# EasyEDA Pro project Access Control Core.eprj, board Card Reader (continued)
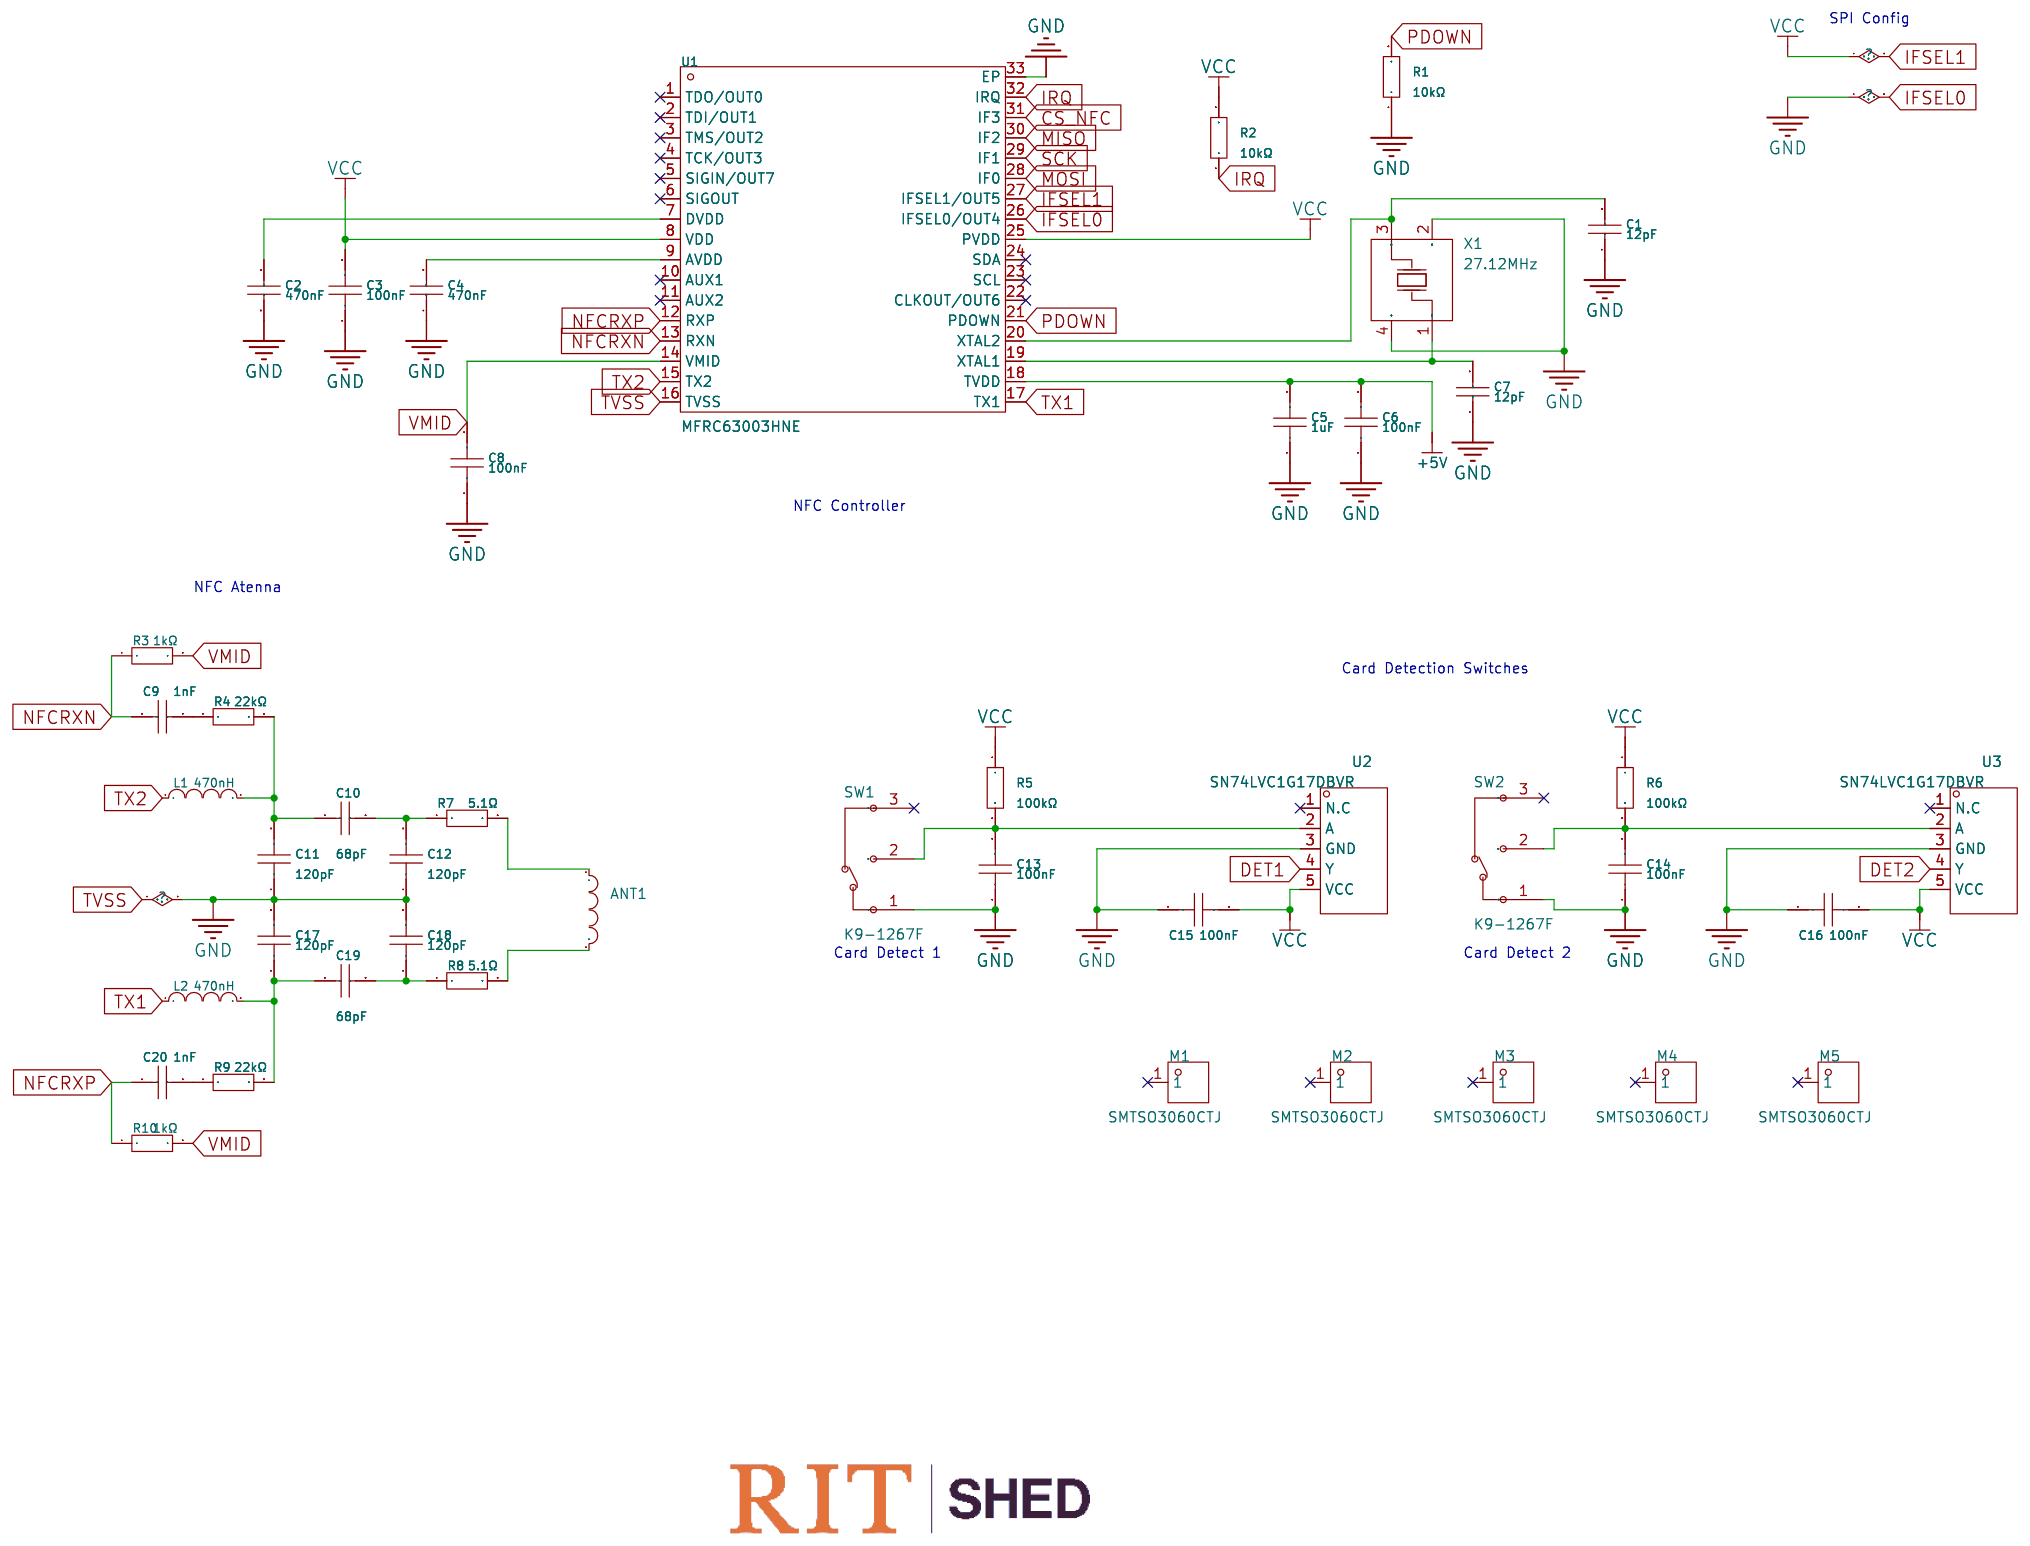
[diagram p0: NFC Reader]
## Routing (per net, layer and track width the routed paths; a pad name or vN(x,y) marks a point on that pad's centre or on a via; arc(x,y) is an arc through that point) (continued)
W_ACT: length 41.4
  Top Layer w0.254: U17.27 v1(81.44,56.39)
  Inner2 w0.254: v1(81.44,56.39) 81.44,59.21 82.17,59.94 82.17,76.33 81.79,76.71 80.45,76.71 79.88,77.27 79.88,78.49 78.49,79.88 78.49,87.1 J3.11
W_LINK: length 41
  Top Layer w0.254: U17.25 v1(79.63,54.93)
  Inner2 w0.254: v1(79.63,54.93) 81.48,54.93 82.17,55.63 82.17,59.44 82.52,59.8 82.52,78.26 81.03,79.76 81.03,90.83 J3.10
W_MISO: length 16.7
  Top Layer w0.254: v1(78.87,46.74) 78.87,47.8 U16.2 ; v1(84.58,57.4) 84.96,57.02 84.96,54.96 U17.34
  Bottom Layer w0.254: v1(84.58,57.4) 84.58,52.45 v1(78.87,46.74)
W_XI: length 10
  Top Layer w0.254: C89.1 84.26,48.03 X2.3 84.96,49.53 84.96,50.75 84.02,51.69 83.83,51.69 R45.1 82.94,52.58 U17.30
W_XO: length 8.4
  Top Layer w0.254: C83.1 87.25,51.31 X2.1 86.06,50.96 R45.2 83.44,53.59 U17.31
$2N2483: length 2.2
  Top Layer w0.381: 49.45,26.35 48.89,26.91 C4.2
$2N2484: length 2.8
  Top Layer w0.381: C2.1 51.94,27.21 U1.7
$2N2490: length 9.4
  Top Layer w0.254: U1.19 46.61,21.17 46.61,16.87 X1.1 47.8,14.03 48,13.82
$2N2492: length 8.1
  Top Layer w0.254: C1.2 50.17,17.26 X1.3 47.37,20.06 47.37,21.23 48.03,21.89
$2N2516: length 7.2
  Top Layer w0.254: R4.2 40.07,27.68 L1.2 38.42,25.7 C11.2 37.4,26.72 C10.1
$2N2517: length 7.2
  Top Layer w0.254: C19.1 37.4,20.11 C17.1 38.42,21.13 L2.2 40.01,21.07 R9.2
$2N2518: length 4.9
  Top Layer w0.254: R8.1 31.31,20.11 C18.1 33.66,20.43 C19.2
$2N2519: length 4.9
  Top Layer w0.254: R7.1 31.31,26.72 C12.2 33.66,26.4 C10.2
$2N2522: length 2.8
  Top Layer w0.254: R8.2 25.02,20.11
$2N2523: length 3.1
  Top Layer w0.254: ANT1.1 27.77,26.67 R7.2
$2N2526: length 2.6
  Top Layer w0.254: C20.2 40.07,17.64 R9.1
$2N2527: length 2.6
  Top Layer w0.254: R4.1 40.07,29.19 C9.2
$2N2535: length 12.2
  Top Layer w0.254: C13.2 37.02,55.05 R5.2 36.71,54.86 SW1.2 32.54,54.61 28.07,54.61 27.81,54.86 U2.2
$2N2541: length 8.1
  Top Layer w0.254: SW2.2 60.39,54.86 C14.2 R6.2 60.59,56.9 U3.2
$4N2195: length 12
  Top Layer w0.254: 63.67,89.02 61.85,89.02 61.34,88.51 U4.2 61.34,84.33 60.83,83.82 60.07,83.82 59.63,83.37 C23.2 58.49,83.32 R11.2
$4N3264: length 8
  Top Layer w0.508: CN2.3 CN2.1 38.58,70.01 C21.1 37.32,68.75 F1.2
$4N3267: length 12.4
  Top Layer w0.508: CN2.4 40.5,78.31 38.65,78.31 CN2.2 36.07,78.23 33.78,75.95 33.08,75.95 C22.2 31.98,74.85 F2.1
$4N23713: length 9.9
  Top Layer w0.508: 10.41,88.6 10.41,89.79 9.77,90.43 U22.1 7.81,90.43 C102.2 ; 10.41,88.6 10.41,87.25 8.59,85.42 F5.2 ; 10.41,88.6 10.34,88.53 U22.3
$5N11060: length 1.7
  Top Layer w0.254: U11.3 9.1,55.08 R19.1
$5N11102: length 1.9
  Top Layer w0.254: U10.3 20.1,61.43 R18.1
$5N11144: length 2.3
  Top Layer w0.254: R17.1 69.4,53.92 U9.3
$5N11186: length 3.4
  Top Layer w0.254: U8.3 58.48,70.29 58.94,70.75 R16.1
$6N1500: length 61.4
  Top Layer w0.381: C53.2 2.8,37.14 3.93,37.14 4.2,37.41 ; v1(3.3,39.88) v1(3.3,38.86) 3.3,38.42 C54.2 ; C54.2 4.2,37.41 ; C54.2 5.14,38.35 6.54,38.35 7.43,37.47 ; 4.2,37.41 U13.3 ; v1(28.83,62.74) v1(28.83,64.09) D6.1 D7.1
  Bottom Layer w0.381: v1(28.83,64.09) v1(28.83,62.74) 28.26,62.17 15.3,62.17 12.83,59.69 8.26,59.69 5.97,57.4 5.97,43.43 3.3,40.77 v1(3.3,39.88) v1(3.3,38.86)
$6N1512: length 1.8
  Top Layer w0.254: U13.6 4.2,33.46 C60.1
$6N1514: length 4.4
  Top Layer w0.381: 3.94,30.79 3.24,31.49 C60.2 3.7,33.48 U13.5
$6N1519: length 2.7
  Top Layer w0.254: U13.7 4.7,34.17 4.95,33.91 6.54,33.91 C59.1
$6N1532: length 10.8
  Top Layer w0.254: R29.2 8.56,28.69 C51.1 R28.1 7.75,31.25 7.75,34.54 7.49,34.8 5.21,34.8 5.2,34.79 U13.8
$6N1538: length 1.9
  Top Layer w0.254: R29.1 10.29,25.66 R30.2
$6N1557: length 1.7
  Top Layer w0.254: U15.6 84.2,28.01 C72.1
$6N1559: length 4.4
  Top Layer w0.381: 84.74,30.39 85.41,29.72 C72.2 84.7,27.48 U15.5
$6N1564: length 3.1
  Top Layer w0.254: C71.1 83.25,27.62 83.7,27.17 U15.7
$6N1580: length 5.4
  Top Layer w0.254: R32.1 R33.1 79.87,26.92 82.82,26.92 U15.8
$6N1585: length 23.5
  Top Layer w0.254: R35.2 78.88,30.48 79.19,30.48 C66.2 ; 79.95,36.7 C69.2 76.39,38.67 75.95,39.12 75.95,40.78 R36.2
  Top Layer w0.508: F6.1 85.13,36.31 L4.2 84.82,36.42
  Top Layer w0.762: 84.19,36.96 83.95,36.71 80.08,36.71 C70.2 C68.2 C67.2 C66.2 ; L4.2 84.19,36.83
$6N1603: length 1.5
  Top Layer w0.254: R34.2 R35.1
$6N1605: length 1.5
  Top Layer w0.254: R33.2 R34.1
$6N12849: length 10
  Top Layer w0.254: F6.2 84.25,41.45 83.7,40.9 U21.3
  Top Layer w0.508: C100.2 85.24,38.8 86.01,39.56 86.74,39.56 87.46,40.28 87.46,41.37 F6.2 ; 85.22,38.67 85.09,38.55 U21.1
$7N2177: length 2.2
  Top Layer w0.254: C88.2 76.8,57.43 U17.22
$7N2179: length 3.4
  Top Layer w0.254: U17.20 78.09,58.43 77.6,58.93 77.6,59.63 C87.2
$7N2183: length 2.7
  Top Layer w0.254: U17.10 81.44,65 R38.2
$7N2200: length 17.8
  Top Layer w0.254: J3.9 82.65,89.92 68.97,89.92 R46.1
$7N2211: length 5.9
  Top Layer w0.254: 78.52,78 77.85,77.32 R43.1 79.58,74.16 C86.2
$7N2220: length 12.5
  Top Layer w0.211: R48.1 71.75,73.41 73.85,73.41 C90.2 76.27,74.11 ; J3.5 77.04,80.32 77.04,76.91 76.4,76.27 76.4,74.23
$7N2225: length 3.1
  Top Layer w0.254: R44.1 71.17,91.69 J3.12
$7N8984: length 6.4
  Top Layer w0.211: C85.1 73.6,74.93 75.57,74.93 75.98,75.35 J3.6
$7N9022: length 16.3
  Top Layer w0.254: J3.3 81.05,81.79 83.69,81.79 85.73,79.76 85.73,73.66 85.47,73.41 83.89,73.41 C84.1
$8N11191: length 6.3
  Top Layer w0.508: 42.72,64.26 41.4,64.26 41.02,64.64 41.02,66.8 40.51,67.31 H1.1
$8N11344: length 2.1
  Top Layer w0.254: R61.2 LED3.1
$9N804: length 3.6
  Top Layer w0.254: R57.2 85.66,11.63 U20.3
$9N828: length 6.1
  Top Layer w0.254: R57.1 83.31,10.78 LED2.4 LED1.4
$9N1371: length 5.7
  Top Layer w0.381: BZR1.2 2.92,9.65 2.92,11.68 D8.2
$9N1449: length 1.5
  Top Layer w0.254: R58.2 3.87,15.06 Q1.1

## Copper pours and planes (outline as drawn; the poured copper is in the pictures)
GND on Top Layer: -3.17,102.11 92.33,102.11 92.33,-9.14 -3.17,-9.14
GND on Bottom Layer: -2.67,99.31 90.8,99.31 90.8,-2.03 -2.67,-2.03
GND on Inner1: -1.65,101.09 92.08,101.09 92.08,-3.81 -1.65,-3.81
GND on Inner2: -1.65,101.35 91.31,101.35 91.31,-3.05 -1.65,-3.05

Small or netless copper shapes (teardrops, artwork), in the pictures only: 959 on Top Layer, 153 on Bottom Layer, 17 on Inner1, 62 on Inner2

## Text on the board
Top Silkscreen Layer: +5V | VCC | 5 | G | R | T | GND | Dec / 2025 | V3.0.0 | ACS Core
